# Altium schematic sheet P_Supply.SchDoc
size 594 x 420 mm; Author: ALTIUM GOSTBOM2.0 KEV; SheetNumber: 28; SheetTotal: 48
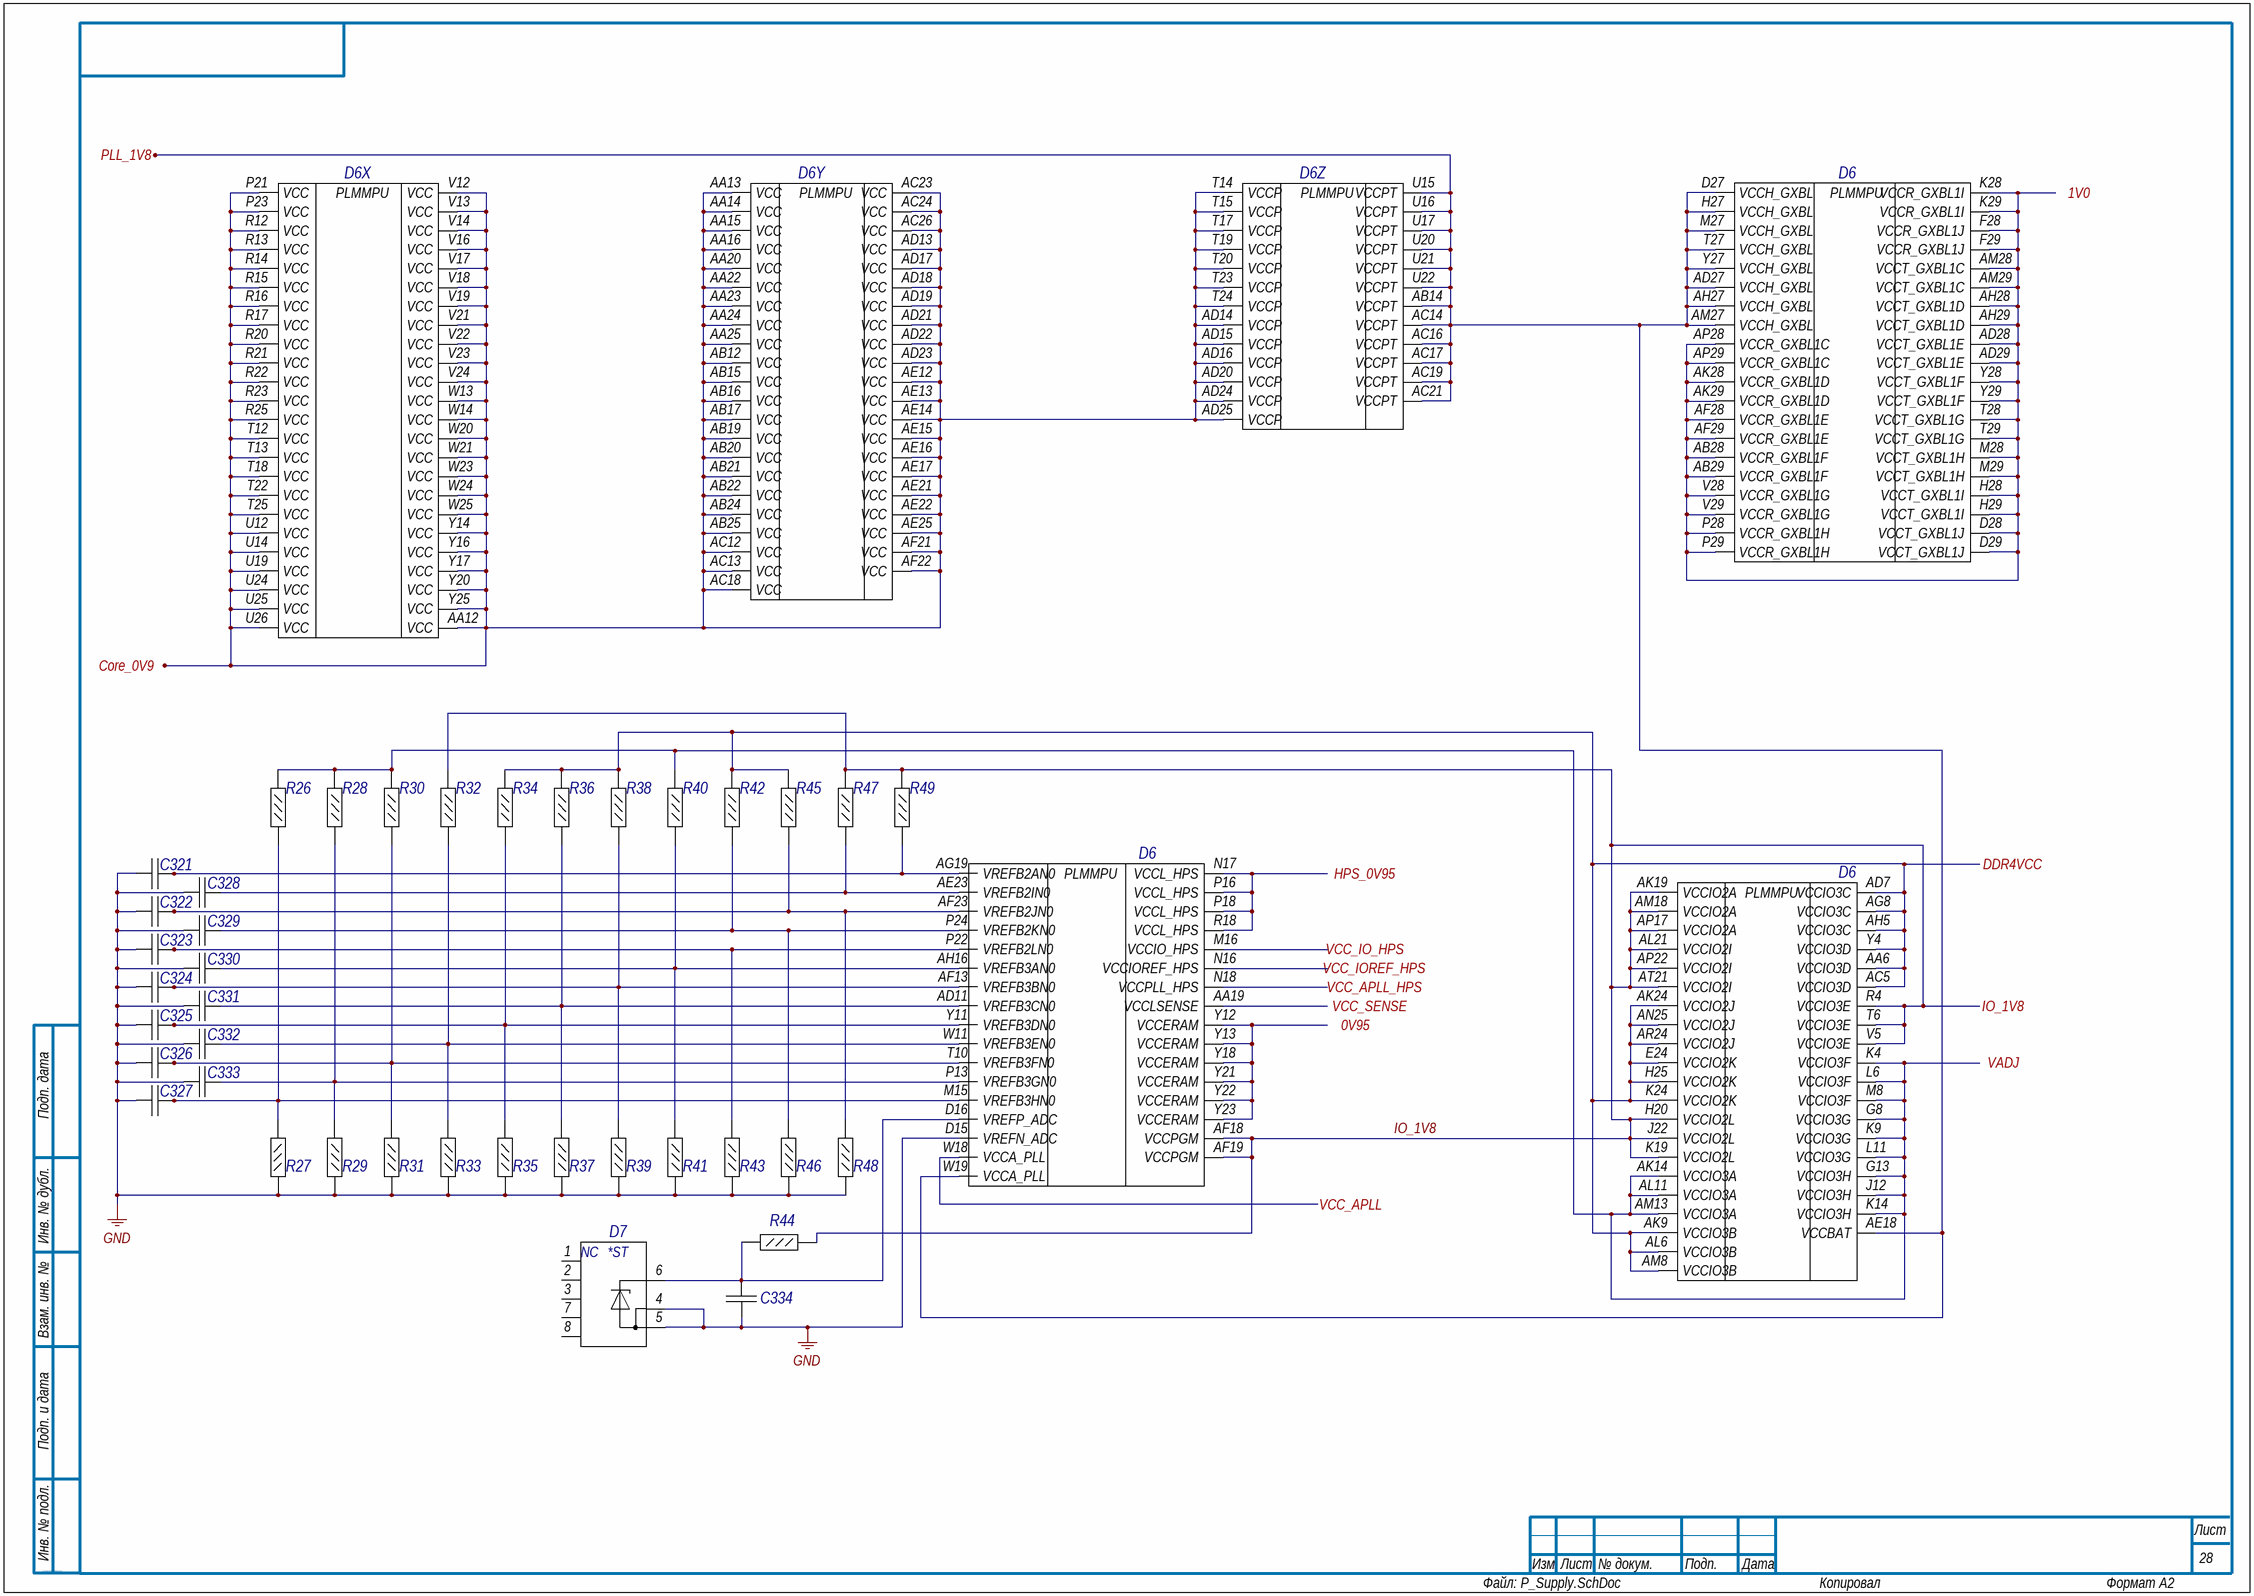
[diagram p0: P_Supply.SchDoc]

## Parts
C321  GRM033R60J104KE19D  [CAPC0603X33X15LL03T05]  (value not drawn)
C322  GRM033R60J104KE19D  [CAPC0603X33X15LL03T05]  (value not drawn)
C323  GRM033R60J104KE19D  [CAPC0603X33X15LL03T05]  (value not drawn)
C324  GRM033R60J104KE19D  [CAPC0603X33X15LL03T05]  (value not drawn)
C325  GRM033R60J104KE19D  [CAPC0603X33X15LL03T05]  (value not drawn)
C326  GRM033R60J104KE19D  [CAPC0603X33X15LL03T05]  (value not drawn)
C327  GRM033R60J104KE19D  [CAPC0603X33X15LL03T05]  (value not drawn)
C328  GRM033R60J104KE19D  [CAPC0603X33X15LL03T05]  (value not drawn)
C329  GRM033R60J104KE19D  [CAPC0603X33X15LL03T05]  (value not drawn)
C330  GRM033R60J104KE19D  [CAPC0603X33X15LL03T05]  (value not drawn)
C331  GRM033R60J104KE19D  [CAPC0603X33X15LL03T05]  (value not drawn)
C332  GRM033R60J104KE19D  [CAPC0603X33X15LL03T05]  (value not drawn)
C333  GRM033R60J104KE19D  [CAPC0603X33X15LL03T05]  (value not drawn)
C334  C1005X7R1E104M  [CAPC1005X55X10LL05]  (value not drawn)
D6  10AS066N3F40E2SGE2  [ALTR-FBGA1517_A-350]  (value not drawn)  (parts X,Y,Z,27,28,29 of 39)
D7  LT1389ACS8-1.25  [LT-S8-8_M]  (value not drawn)
R26  ERJ-2GEJ241x  [RESC1005X40X25LL05T05]  (value not drawn)
R27  ERJ-2GEJ241x  [RESC1005X40X25LL05T05]  (value not drawn)
R28  ERJ-2GEJ241x  [RESC1005X40X25LL05T05]  (value not drawn)
R29  ERJ-2GEJ241x  [RESC1005X40X25LL05T05]  (value not drawn)
R30  ERJ-2GEJ241x  [RESC1005X40X25LL05T05]  (value not drawn)
R31  ERJ-2GEJ241x  [RESC1005X40X25LL05T05]  (value not drawn)
R32  ERJ-2GEJ241x  [RESC1005X40X25LL05T05]  (value not drawn)
R33  ERJ-2GEJ241x  [RESC1005X40X25LL05T05]  (value not drawn)
R34  ERJ-2GEJ241x  [RESC1005X40X25LL05T05]  (value not drawn)
R35  ERJ-2GEJ241x  [RESC1005X40X25LL05T05]  (value not drawn)
R36  ERJ-2GEJ241x  [RESC1005X40X25LL05T05]  (value not drawn)
R37  ERJ-2GEJ241x  [RESC1005X40X25LL05T05]  (value not drawn)
R38  ERJ-2GEJ241x  [RESC1005X40X25LL05T05]  (value not drawn)
R39  ERJ-2GEJ241x  [RESC1005X40X25LL05T05]  (value not drawn)
R40  ERJ-2GEJ241x  [RESC1005X40X25LL05T05]  (value not drawn)
R41  ERJ-2GEJ241x  [RESC1005X40X25LL05T05]  (value not drawn)
R42  ERJ-2GEJ241x  [RESC1005X40X25LL05T05]  (value not drawn)
R43  ERJ-2GEJ241x  [RESC1005X40X25LL05T05]  (value not drawn)
R44  ERJ-2RKF1003X  [RESC1005X40X25LL05T05]  (value not drawn)
R45  ERJ-2GEJ241x  [RESC1005X40X25LL05T05]  (value not drawn)
R46  ERJ-2GEJ241x  [RESC1005X40X25LL05T05]  (value not drawn)
R47  ERJ-2GEJ241x  [RESC1005X40X25LL05T05]  (value not drawn)
R48  ERJ-2GEJ241x  [RESC1005X40X25LL05T05]  (value not drawn)
R49  ERJ-2GEJ241x  [RESC1005X40X25LL05T05]  (value not drawn)

## Ports
0V95, 1V0, Core_0V9, DDR4VCC, HPS_0V95, IO_1V8, PLL_1V8, VADJ, VCC_APLL, VCC_APLL_HPS, VCC_IO_HPS, VCC_IOREF_HPS, VCC_SENSE

## Nets
GND: C321.1 C322.1 C323.1 C324.1 C325.1 C326.1 C327.1 C328.1 C329.1 C330.1 C331.1 C332.1 C333.1 C334.1 D6.D15(VREFN_ADC) D7.4(GND) D7.5(GND) R27.1 R29.2 R31.2 R33.2 R35.2 R37.2 R39.2 R41.2 R43.2 R46.2 R48.2
0V95: D6.Y12(VCCERAM) D6.Y13(VCCERAM) D6.Y18(VCCERAM) D6.Y21(VCCERAM) D6.Y22(VCCERAM) D6.Y23(VCCERAM) ; port 0V95
1V0: D6.AB28(VCCR_GXBL1F) D6.AB29(VCCR_GXBL1F) D6.AD28(VCCT_GXBL1E) D6.AD29(VCCT_GXBL1E) D6.AF28(VCCR_GXBL1E) D6.AF29(VCCR_GXBL1E) D6.AH28(VCCT_GXBL1D) D6.AH29(VCCT_GXBL1D) D6.AK28(VCCR_GXBL1D) D6.AK29(VCCR_GXBL1D) D6.AM28(VCCT_GXBL1C) D6.AM29(VCCT_GXBL1C) D6.AP28(VCCR_GXBL1C) D6.AP29(VCCR_GXBL1C) D6.D28(VCCT_GXBL1J) D6.D29(VCCT_GXBL1J) D6.F28(VCCR_GXBL1J) D6.F29(VCCR_GXBL1J) D6.H28(VCCT_GXBL1I) D6.H29(VCCT_GXBL1I) D6.K28(VCCR_GXBL1I) D6.K29(VCCR_GXBL1I) D6.M28(VCCT_GXBL1H) D6.M29(VCCT_GXBL1H) D6.P28(VCCR_GXBL1H) D6.P29(VCCR_GXBL1H) D6.T28(VCCT_GXBL1G) D6.T29(VCCT_GXBL1G) D6.V28(VCCR_GXBL1G) D6.V29(VCCR_GXBL1G) D6.Y28(VCCT_GXBL1F) D6.Y29(VCCT_GXBL1F) ; port 1V0
Core_0V9: D6.AA12(VCC) D6.AA13(VCC) D6.AA14(VCC) D6.AA15(VCC) D6.AA16(VCC) D6.AA20(VCC) D6.AA22(VCC) D6.AA23(VCC) D6.AA24(VCC) D6.AA25(VCC) D6.AB12(VCC) D6.AB15(VCC) D6.AB16(VCC) D6.AB17(VCC) D6.AB19(VCC) D6.AB20(VCC) D6.AB21(VCC) D6.AB22(VCC) D6.AB24(VCC) D6.AB25(VCC) D6.AC12(VCC) D6.AC13(VCC) D6.AC18(VCC) D6.AC23(VCC) D6.AC24(VCC) D6.AC26(VCC) D6.AD13(VCC) D6.AD14(VCCP) D6.AD15(VCCP) D6.AD16(VCCP) D6.AD17(VCC) D6.AD18(VCC) D6.AD19(VCC) D6.AD20(VCCP) D6.AD21(VCC) D6.AD22(VCC) D6.AD23(VCC) D6.AD24(VCCP) D6.AD25(VCCP) D6.AE12(VCC) D6.AE13(VCC) D6.AE14(VCC) D6.AE15(VCC) D6.AE16(VCC) D6.AE17(VCC) D6.AE21(VCC) D6.AE22(VCC) D6.AE25(VCC) D6.AF21(VCC) D6.AF22(VCC) D6.P21(VCC) D6.P23(VCC) D6.R12(VCC) D6.R13(VCC) D6.R14(VCC) D6.R15(VCC) D6.R16(VCC) D6.R17(VCC) D6.R20(VCC) D6.R21(VCC) D6.R22(VCC) D6.R23(VCC) D6.R25(VCC) D6.T12(VCC) D6.T13(VCC) D6.T14(VCCP) D6.T15(VCCP) D6.T17(VCCP) D6.T18(VCC) D6.T19(VCCP) D6.T20(VCCP) D6.T22(VCC) D6.T23(VCCP) D6.T24(VCCP) D6.T25(VCC) D6.U12(VCC) D6.U14(VCC) D6.U19(VCC) D6.U24(VCC) D6.U25(VCC) D6.U26(VCC) D6.V12(VCC) D6.V13(VCC) D6.V14(VCC) D6.V16(VCC) D6.V17(VCC) D6.V18(VCC) D6.V19(VCC) D6.V21(VCC) D6.V22(VCC) D6.V23(VCC) D6.V24(VCC) D6.W13(VCC) D6.W14(VCC) D6.W20(VCC) D6.W21(VCC) D6.W23(VCC) D6.W24(VCC) D6.W25(VCC) D6.Y14(VCC) D6.Y16(VCC) D6.Y17(VCC) D6.Y20(VCC) D6.Y25(VCC) ; port Core_0V9
DDR4VCC: D6.AA6(VCCIO3D) D6.AC5(VCCIO3D) D6.AD7(VCCIO3C) D6.AG8(VCCIO3C) D6.AH5(VCCIO3C) D6.AK9(VCCIO3B) D6.AK24(VCCIO2J) D6.AL6(VCCIO3B) D6.AM8(VCCIO3B) D6.AN25(VCCIO2J) D6.AR24(VCCIO2J) D6.E24(VCCIO2K) D6.H25(VCCIO2K) D6.K24(VCCIO2K) D6.Y4(VCCIO3D) R34.1 R36.1 R38.1 R42.1 R45.1 ; port DDR4VCC
HPS_0V95: D6.N17(VCCL_HPS) D6.P16(VCCL_HPS) D6.P18(VCCL_HPS) D6.R18(VCCL_HPS) ; port HPS_0V95
IO_1V8: D6.AF18(VCCPGM) D6.AF19(VCCPGM) D6.AK19(VCCIO2A) D6.AL21(VCCIO2I) D6.AM18(VCCIO2A) D6.AP17(VCCIO2A) D6.AP22(VCCIO2I) D6.AT21(VCCIO2I) D6.H20(VCCIO2L) D6.J22(VCCIO2L) D6.K19(VCCIO2L) D6.R4(VCCIO3E) D6.T6(VCCIO3E) D6.V5(VCCIO3E) R32.1 R44.1 R47.1 R49.1 ; port IO_1V8
PLL_1V8: D6.AB14(VCCPT) D6.AC14(VCCPT) D6.AC16(VCCPT) D6.AC17(VCCPT) D6.AC19(VCCPT) D6.AC21(VCCPT) D6.AD27(VCCH_GXBL) D6.AE18(VCCBAT) D6.AH27(VCCH_GXBL) D6.AM27(VCCH_GXBL) D6.D27(VCCH_GXBL) D6.H27(VCCH_GXBL) D6.M27(VCCH_GXBL) D6.T27(VCCH_GXBL) D6.U15(VCCPT) D6.U16(VCCPT) D6.U17(VCCPT) D6.U20(VCCPT) D6.U21(VCCPT) D6.U22(VCCPT) D6.W19(VCCA_PLL) D6.Y27(VCCH_GXBL) ; port PLL_1V8
VADJ: D6.AK14(VCCIO3A) D6.AL11(VCCIO3A) D6.AM13(VCCIO3A) D6.G8(VCCIO3G) D6.G13(VCCIO3H) D6.J12(VCCIO3H) D6.K4(VCCIO3F) D6.K9(VCCIO3G) D6.K14(VCCIO3H) D6.L6(VCCIO3F) D6.L11(VCCIO3G) D6.M8(VCCIO3F) R26.1 R28.1 R30.1 R40.1 ; port VADJ
VCC_APLL: D6.W18(VCCA_PLL) ; port VCC_APLL
VCC_APLL_HPS: D6.N18(VCCPLL_HPS) ; port VCC_APLL_HPS
VCC_IO_HPS: D6.M16(VCCIO_HPS) ; port VCC_IO_HPS
VCC_IOREF_HPS: D6.N16(VCCIOREF_HPS) ; port VCC_IOREF_HPS
VCC_SENSE: D6.AA19(VCCLSENSE) ; port VCC_SENSE
NetC321_2: C321.2 D6.AG19(VREFB2AN0) R49.2
NetC322_2: C322.2 D6.AF23(VREFB2JN0) R45.2 R48.1
NetC323_2: C323.2 D6.P22(VREFB2LN0) R43.1
NetC324_2: C324.2 D6.AF13(VREFB3BN0) R38.2 R39.1
NetC325_2: C325.2 D6.Y11(VREFB3DN0) R34.2 R35.1
NetC326_2: C326.2 D6.T10(VREFB3FN0) R30.2 R31.1
NetC327_2: C327.2 D6.M15(VREFB3HN0) R26.2 R27.2
NetC328_2: C328.2 D6.AE23(VREFB2IN0) R47.2
NetC329_2: C329.2 D6.P24(VREFB2KN0) R42.2 R46.1
NetC330_2: C330.2 D6.AH16(VREFB3AN0) R40.2 R41.1
NetC331_2: C331.2 D6.AD11(VREFB3CN0) R36.2 R37.1
NetC332_2: C332.2 D6.W11(VREFB3EN0) R32.2 R33.1
NetC333_2: C333.2 D6.P13(VREFB3GN0) R28.2 R29.1
NetC334_2: C334.2 D6.D16(VREFP_ADC) D7.6(VOUT) R44.2

Not connected (* = marked no-connect by the designer): D7 1(NC) 2(NC) 3(NC) 7(NC) 8(NC)

## Notes on the sheet
- Подп. дата
- Инв. № дубл.
- Взам. инв. №
- Подп. и дата
- Инв. № подл.
- Изм.
- Лист
- № докум.
- Подп.
- Дата
- ALTIUM GOSTBOM2.0 KEV
- Файл:
- Копировал
- Формат А2
- (in symbol E105, part X) PLMMPU
- (in symbol E105, part Y) PLMMPU
- (in symbol E105, part Z) PLMMPU
- (in symbol E105, part 27) PLMMPU
- (in symbol E105, part 28) PLMMPU
- (in symbol E105, part 29) PLMMPU
- (in symbol E113) *ST

## Library data of the parts
C321 = E22: Chip Capacitor, 100 nF, +/- 10%, 6.3 V, -55 to 85 degC, 0201 (0603 Metric), RoHS, Tape and Reel; Manufacturer: Basic Passives; Тип элемента: Конденсатор; Capacitance: 100 nF; Case\/Package: 0201; Type (Capacitors): X5R; Voltage Rating: 6.3 V; Voltage Rating (DC): 3 V; Old_des: C118; New_des: C321; UID: E22; Component Kind: Standard; Case Code (Imperial): 0201; Case Code (Metric): 0603; ComponentLink1Description: Manufacturer URL; ComponentLink1URL: http://www.murata.com/; ComponentLink2Description: Datasheet; ComponentLink2URL: http://search.murata.co.jp/Ceramy/image/img/A01X/G101/ENG/GRM033R60J104KE19-01.pdf; DatasheetVersion: 03/2016; Length: 0.6 mm; Max Operating Temperature: 85 degC; Min Operating Temperature: -55 degC; Mounting Technology: Surface Mount; Package Quantity: 15000; PackageDescription: 2-Pin Surface Mount Device, Body 0.6 x 0.3 mm; Packaging: Tape and Reel; PartNumber: GRM033R60J104KE19D; RoHSCompliant: true; Tolerance: 10%; Width: 0.3 mm; Height: 0.3 mm; Mount: Surface Mount; PackageReference: 0201; Pins: 2; Radiation Hardening: No; REACH SVHC: No SVHC
C322 = E22: Chip Capacitor, 100 nF, +/- 10%, 6.3 V, -55 to 85 degC, 0201 (0603 Metric), RoHS, Tape and Reel; Manufacturer: Basic Passives; Тип элемента: Конденсатор; Capacitance: 100 nF; Case\/Package: 0201; Type (Capacitors): X5R; Voltage Rating: 6.3 V; Voltage Rating (DC): 3 V; Old_des: C120; New_des: C322; UID: E22; Component Kind: Standard; Case Code (Imperial): 0201; Case Code (Metric): 0603; ComponentLink1Description: Manufacturer URL; ComponentLink1URL: http://www.murata.com/; ComponentLink2Description: Datasheet; ComponentLink2URL: http://search.murata.co.jp/Ceramy/image/img/A01X/G101/ENG/GRM033R60J104KE19-01.pdf; DatasheetVersion: 03/2016; Length: 0.6 mm; Max Operating Temperature: 85 degC; Min Operating Temperature: -55 degC; Mounting Technology: Surface Mount; Package Quantity: 15000; PackageDescription: 2-Pin Surface Mount Device, Body 0.6 x 0.3 mm; Packaging: Tape and Reel; PartNumber: GRM033R60J104KE19D; RoHSCompliant: true; Tolerance: 10%; Width: 0.3 mm; Height: 0.3 mm; Mount: Surface Mount; PackageReference: 0201; Pins: 2; Radiation Hardening: No; REACH SVHC: No SVHC
C323 = E22: Chip Capacitor, 100 nF, +/- 10%, 6.3 V, -55 to 85 degC, 0201 (0603 Metric), RoHS, Tape and Reel; Manufacturer: Basic Passives; Тип элемента: Конденсатор; Capacitance: 100 nF; Case\/Package: 0201; Type (Capacitors): X5R; Voltage Rating: 6.3 V; Voltage Rating (DC): 3 V; Old_des: C122; New_des: C323; UID: E22; Component Kind: Standard; Case Code (Imperial): 0201; Case Code (Metric): 0603; ComponentLink1Description: Manufacturer URL; ComponentLink1URL: http://www.murata.com/; ComponentLink2Description: Datasheet; ComponentLink2URL: http://search.murata.co.jp/Ceramy/image/img/A01X/G101/ENG/GRM033R60J104KE19-01.pdf; DatasheetVersion: 03/2016; Length: 0.6 mm; Max Operating Temperature: 85 degC; Min Operating Temperature: -55 degC; Mounting Technology: Surface Mount; Package Quantity: 15000; PackageDescription: 2-Pin Surface Mount Device, Body 0.6 x 0.3 mm; Packaging: Tape and Reel; PartNumber: GRM033R60J104KE19D; RoHSCompliant: true; Tolerance: 10%; Width: 0.3 mm; Height: 0.3 mm; Mount: Surface Mount; PackageReference: 0201; Pins: 2; Radiation Hardening: No; REACH SVHC: No SVHC
C324 = E22: Chip Capacitor, 100 nF, +/- 10%, 6.3 V, -55 to 85 degC, 0201 (0603 Metric), RoHS, Tape and Reel; Manufacturer: Basic Passives; Тип элемента: Конденсатор; Capacitance: 100 nF; Case\/Package: 0201; Type (Capacitors): X5R; Voltage Rating: 6.3 V; Voltage Rating (DC): 3 V; Old_des: C124; New_des: C324; UID: E22; Component Kind: Standard; Case Code (Imperial): 0201; Case Code (Metric): 0603; ComponentLink1Description: Manufacturer URL; ComponentLink1URL: http://www.murata.com/; ComponentLink2Description: Datasheet; ComponentLink2URL: http://search.murata.co.jp/Ceramy/image/img/A01X/G101/ENG/GRM033R60J104KE19-01.pdf; DatasheetVersion: 03/2016; Length: 0.6 mm; Max Operating Temperature: 85 degC; Min Operating Temperature: -55 degC; Mounting Technology: Surface Mount; Package Quantity: 15000; PackageDescription: 2-Pin Surface Mount Device, Body 0.6 x 0.3 mm; Packaging: Tape and Reel; PartNumber: GRM033R60J104KE19D; RoHSCompliant: true; Tolerance: 10%; Width: 0.3 mm; Height: 0.3 mm; Mount: Surface Mount; PackageReference: 0201; Pins: 2; Radiation Hardening: No; REACH SVHC: No SVHC
C325 = E22: Chip Capacitor, 100 nF, +/- 10%, 6.3 V, -55 to 85 degC, 0201 (0603 Metric), RoHS, Tape and Reel; Manufacturer: Basic Passives; Тип элемента: Конденсатор; Capacitance: 100 nF; Case\/Package: 0201; Type (Capacitors): X5R; Voltage Rating: 6.3 V; Voltage Rating (DC): 3 V; Old_des: C126; New_des: C325; UID: E22; Component Kind: Standard; Case Code (Imperial): 0201; Case Code (Metric): 0603; ComponentLink1Description: Manufacturer URL; ComponentLink1URL: http://www.murata.com/; ComponentLink2Description: Datasheet; ComponentLink2URL: http://search.murata.co.jp/Ceramy/image/img/A01X/G101/ENG/GRM033R60J104KE19-01.pdf; DatasheetVersion: 03/2016; Length: 0.6 mm; Max Operating Temperature: 85 degC; Min Operating Temperature: -55 degC; Mounting Technology: Surface Mount; Package Quantity: 15000; PackageDescription: 2-Pin Surface Mount Device, Body 0.6 x 0.3 mm; Packaging: Tape and Reel; PartNumber: GRM033R60J104KE19D; RoHSCompliant: true; Tolerance: 10%; Width: 0.3 mm; Height: 0.3 mm; Mount: Surface Mount; PackageReference: 0201; Pins: 2; Radiation Hardening: No; REACH SVHC: No SVHC
C326 = E22: Chip Capacitor, 100 nF, +/- 10%, 6.3 V, -55 to 85 degC, 0201 (0603 Metric), RoHS, Tape and Reel; Manufacturer: Basic Passives; Тип элемента: Конденсатор; Capacitance: 100 nF; Case\/Package: 0201; Type (Capacitors): X5R; Voltage Rating: 6.3 V; Voltage Rating (DC): 3 V; Old_des: C128; New_des: C326; UID: E22; Component Kind: Standard; Case Code (Imperial): 0201; Case Code (Metric): 0603; ComponentLink1Description: Manufacturer URL; ComponentLink1URL: http://www.murata.com/; ComponentLink2Description: Datasheet; ComponentLink2URL: http://search.murata.co.jp/Ceramy/image/img/A01X/G101/ENG/GRM033R60J104KE19-01.pdf; DatasheetVersion: 03/2016; Length: 0.6 mm; Max Operating Temperature: 85 degC; Min Operating Temperature: -55 degC; Mounting Technology: Surface Mount; Package Quantity: 15000; PackageDescription: 2-Pin Surface Mount Device, Body 0.6 x 0.3 mm; Packaging: Tape and Reel; PartNumber: GRM033R60J104KE19D; RoHSCompliant: true; Tolerance: 10%; Width: 0.3 mm; Height: 0.3 mm; Mount: Surface Mount; PackageReference: 0201; Pins: 2; Radiation Hardening: No; REACH SVHC: No SVHC
C327 = E22: Chip Capacitor, 100 nF, +/- 10%, 6.3 V, -55 to 85 degC, 0201 (0603 Metric), RoHS, Tape and Reel; Manufacturer: Basic Passives; Тип элемента: Конденсатор; Capacitance: 100 nF; Case\/Package: 0201; Type (Capacitors): X5R; Voltage Rating: 6.3 V; Voltage Rating (DC): 3 V; Old_des: C130; New_des: C327; UID: E22; Component Kind: Standard; Case Code (Imperial): 0201; Case Code (Metric): 0603; ComponentLink1Description: Manufacturer URL; ComponentLink1URL: http://www.murata.com/; ComponentLink2Description: Datasheet; ComponentLink2URL: http://search.murata.co.jp/Ceramy/image/img/A01X/G101/ENG/GRM033R60J104KE19-01.pdf; DatasheetVersion: 03/2016; Length: 0.6 mm; Max Operating Temperature: 85 degC; Min Operating Temperature: -55 degC; Mounting Technology: Surface Mount; Package Quantity: 15000; PackageDescription: 2-Pin Surface Mount Device, Body 0.6 x 0.3 mm; Packaging: Tape and Reel; PartNumber: GRM033R60J104KE19D; RoHSCompliant: true; Tolerance: 10%; Width: 0.3 mm; Height: 0.3 mm; Mount: Surface Mount; PackageReference: 0201; Pins: 2; Radiation Hardening: No; REACH SVHC: No SVHC
C328 = E22: Chip Capacitor, 100 nF, +/- 10%, 6.3 V, -55 to 85 degC, 0201 (0603 Metric), RoHS, Tape and Reel; Manufacturer: Basic Passives; Тип элемента: Конденсатор; Capacitance: 100 nF; Case\/Package: 0201; Type (Capacitors): X5R; Voltage Rating: 6.3 V; Voltage Rating (DC): 3 V; Old_des: C119; New_des: C328; UID: E22; Component Kind: Standard; Case Code (Imperial): 0201; Case Code (Metric): 0603; ComponentLink1Description: Manufacturer URL; ComponentLink1URL: http://www.murata.com/; ComponentLink2Description: Datasheet; ComponentLink2URL: http://search.murata.co.jp/Ceramy/image/img/A01X/G101/ENG/GRM033R60J104KE19-01.pdf; DatasheetVersion: 03/2016; Length: 0.6 mm; Max Operating Temperature: 85 degC; Min Operating Temperature: -55 degC; Mounting Technology: Surface Mount; Package Quantity: 15000; PackageDescription: 2-Pin Surface Mount Device, Body 0.6 x 0.3 mm; Packaging: Tape and Reel; PartNumber: GRM033R60J104KE19D; RoHSCompliant: true; Tolerance: 10%; Width: 0.3 mm; Height: 0.3 mm; Mount: Surface Mount; PackageReference: 0201; Pins: 2; Radiation Hardening: No; REACH SVHC: No SVHC
C329 = E22: Chip Capacitor, 100 nF, +/- 10%, 6.3 V, -55 to 85 degC, 0201 (0603 Metric), RoHS, Tape and Reel; Manufacturer: Basic Passives; Тип элемента: Конденсатор; Capacitance: 100 nF; Case\/Package: 0201; Type (Capacitors): X5R; Voltage Rating: 6.3 V; Voltage Rating (DC): 3 V; Old_des: C121; New_des: C329; UID: E22; Component Kind: Standard; Case Code (Imperial): 0201; Case Code (Metric): 0603; ComponentLink1Description: Manufacturer URL; ComponentLink1URL: http://www.murata.com/; ComponentLink2Description: Datasheet; ComponentLink2URL: http://search.murata.co.jp/Ceramy/image/img/A01X/G101/ENG/GRM033R60J104KE19-01.pdf; DatasheetVersion: 03/2016; Length: 0.6 mm; Max Operating Temperature: 85 degC; Min Operating Temperature: -55 degC; Mounting Technology: Surface Mount; Package Quantity: 15000; PackageDescription: 2-Pin Surface Mount Device, Body 0.6 x 0.3 mm; Packaging: Tape and Reel; PartNumber: GRM033R60J104KE19D; RoHSCompliant: true; Tolerance: 10%; Width: 0.3 mm; Height: 0.3 mm; Mount: Surface Mount; PackageReference: 0201; Pins: 2; Radiation Hardening: No; REACH SVHC: No SVHC
C330 = E22: Chip Capacitor, 100 nF, +/- 10%, 6.3 V, -55 to 85 degC, 0201 (0603 Metric), RoHS, Tape and Reel; Manufacturer: Basic Passives; Тип элемента: Конденсатор; Capacitance: 100 nF; Case\/Package: 0201; Type (Capacitors): X5R; Voltage Rating: 6.3 V; Voltage Rating (DC): 3 V; Old_des: C123; New_des: C330; UID: E22; Component Kind: Standard; Case Code (Imperial): 0201; Case Code (Metric): 0603; ComponentLink1Description: Manufacturer URL; ComponentLink1URL: http://www.murata.com/; ComponentLink2Description: Datasheet; ComponentLink2URL: http://search.murata.co.jp/Ceramy/image/img/A01X/G101/ENG/GRM033R60J104KE19-01.pdf; DatasheetVersion: 03/2016; Length: 0.6 mm; Max Operating Temperature: 85 degC; Min Operating Temperature: -55 degC; Mounting Technology: Surface Mount; Package Quantity: 15000; PackageDescription: 2-Pin Surface Mount Device, Body 0.6 x 0.3 mm; Packaging: Tape and Reel; PartNumber: GRM033R60J104KE19D; RoHSCompliant: true; Tolerance: 10%; Width: 0.3 mm; Height: 0.3 mm; Mount: Surface Mount; PackageReference: 0201; Pins: 2; Radiation Hardening: No; REACH SVHC: No SVHC
C331 = E22: Chip Capacitor, 100 nF, +/- 10%, 6.3 V, -55 to 85 degC, 0201 (0603 Metric), RoHS, Tape and Reel; Manufacturer: Basic Passives; Тип элемента: Конденсатор; Capacitance: 100 nF; Case\/Package: 0201; Type (Capacitors): X5R; Voltage Rating: 6.3 V; Voltage Rating (DC): 3 V; Old_des: C125; New_des: C331; UID: E22; Component Kind: Standard; Case Code (Imperial): 0201; Case Code (Metric): 0603; ComponentLink1Description: Manufacturer URL; ComponentLink1URL: http://www.murata.com/; ComponentLink2Description: Datasheet; ComponentLink2URL: http://search.murata.co.jp/Ceramy/image/img/A01X/G101/ENG/GRM033R60J104KE19-01.pdf; DatasheetVersion: 03/2016; Length: 0.6 mm; Max Operating Temperature: 85 degC; Min Operating Temperature: -55 degC; Mounting Technology: Surface Mount; Package Quantity: 15000; PackageDescription: 2-Pin Surface Mount Device, Body 0.6 x 0.3 mm; Packaging: Tape and Reel; PartNumber: GRM033R60J104KE19D; RoHSCompliant: true; Tolerance: 10%; Width: 0.3 mm; Height: 0.3 mm; Mount: Surface Mount; PackageReference: 0201; Pins: 2; Radiation Hardening: No; REACH SVHC: No SVHC
C332 = E22: Chip Capacitor, 100 nF, +/- 10%, 6.3 V, -55 to 85 degC, 0201 (0603 Metric), RoHS, Tape and Reel; Manufacturer: Basic Passives; Тип элемента: Конденсатор; Capacitance: 100 nF; Case\/Package: 0201; Type (Capacitors): X5R; Voltage Rating: 6.3 V; Voltage Rating (DC): 3 V; Old_des: C127; New_des: C332; UID: E22; Component Kind: Standard; Case Code (Imperial): 0201; Case Code (Metric): 0603; ComponentLink1Description: Manufacturer URL; ComponentLink1URL: http://www.murata.com/; ComponentLink2Description: Datasheet; ComponentLink2URL: http://search.murata.co.jp/Ceramy/image/img/A01X/G101/ENG/GRM033R60J104KE19-01.pdf; DatasheetVersion: 03/2016; Length: 0.6 mm; Max Operating Temperature: 85 degC; Min Operating Temperature: -55 degC; Mounting Technology: Surface Mount; Package Quantity: 15000; PackageDescription: 2-Pin Surface Mount Device, Body 0.6 x 0.3 mm; Packaging: Tape and Reel; PartNumber: GRM033R60J104KE19D; RoHSCompliant: true; Tolerance: 10%; Width: 0.3 mm; Height: 0.3 mm; Mount: Surface Mount; PackageReference: 0201; Pins: 2; Radiation Hardening: No; REACH SVHC: No SVHC
C333 = E22: Chip Capacitor, 100 nF, +/- 10%, 6.3 V, -55 to 85 degC, 0201 (0603 Metric), RoHS, Tape and Reel; Manufacturer: Basic Passives; Тип элемента: Конденсатор; Capacitance: 100 nF; Case\/Package: 0201; Type (Capacitors): X5R; Voltage Rating: 6.3 V; Voltage Rating (DC): 3 V; Old_des: C129; New_des: C333; UID: E22; Component Kind: Standard; Case Code (Imperial): 0201; Case Code (Metric): 0603; ComponentLink1Description: Manufacturer URL; ComponentLink1URL: http://www.murata.com/; ComponentLink2Description: Datasheet; ComponentLink2URL: http://search.murata.co.jp/Ceramy/image/img/A01X/G101/ENG/GRM033R60J104KE19-01.pdf; DatasheetVersion: 03/2016; Length: 0.6 mm; Max Operating Temperature: 85 degC; Min Operating Temperature: -55 degC; Mounting Technology: Surface Mount; Package Quantity: 15000; PackageDescription: 2-Pin Surface Mount Device, Body 0.6 x 0.3 mm; Packaging: Tape and Reel; PartNumber: GRM033R60J104KE19D; RoHSCompliant: true; Tolerance: 10%; Width: 0.3 mm; Height: 0.3 mm; Mount: Surface Mount; PackageReference: 0201; Pins: 2; Radiation Hardening: No; REACH SVHC: No SVHC